# EasyEDA Pro project ProProject_Avaota Pi A_2024-03-25.epro, board PCB2 (continued)
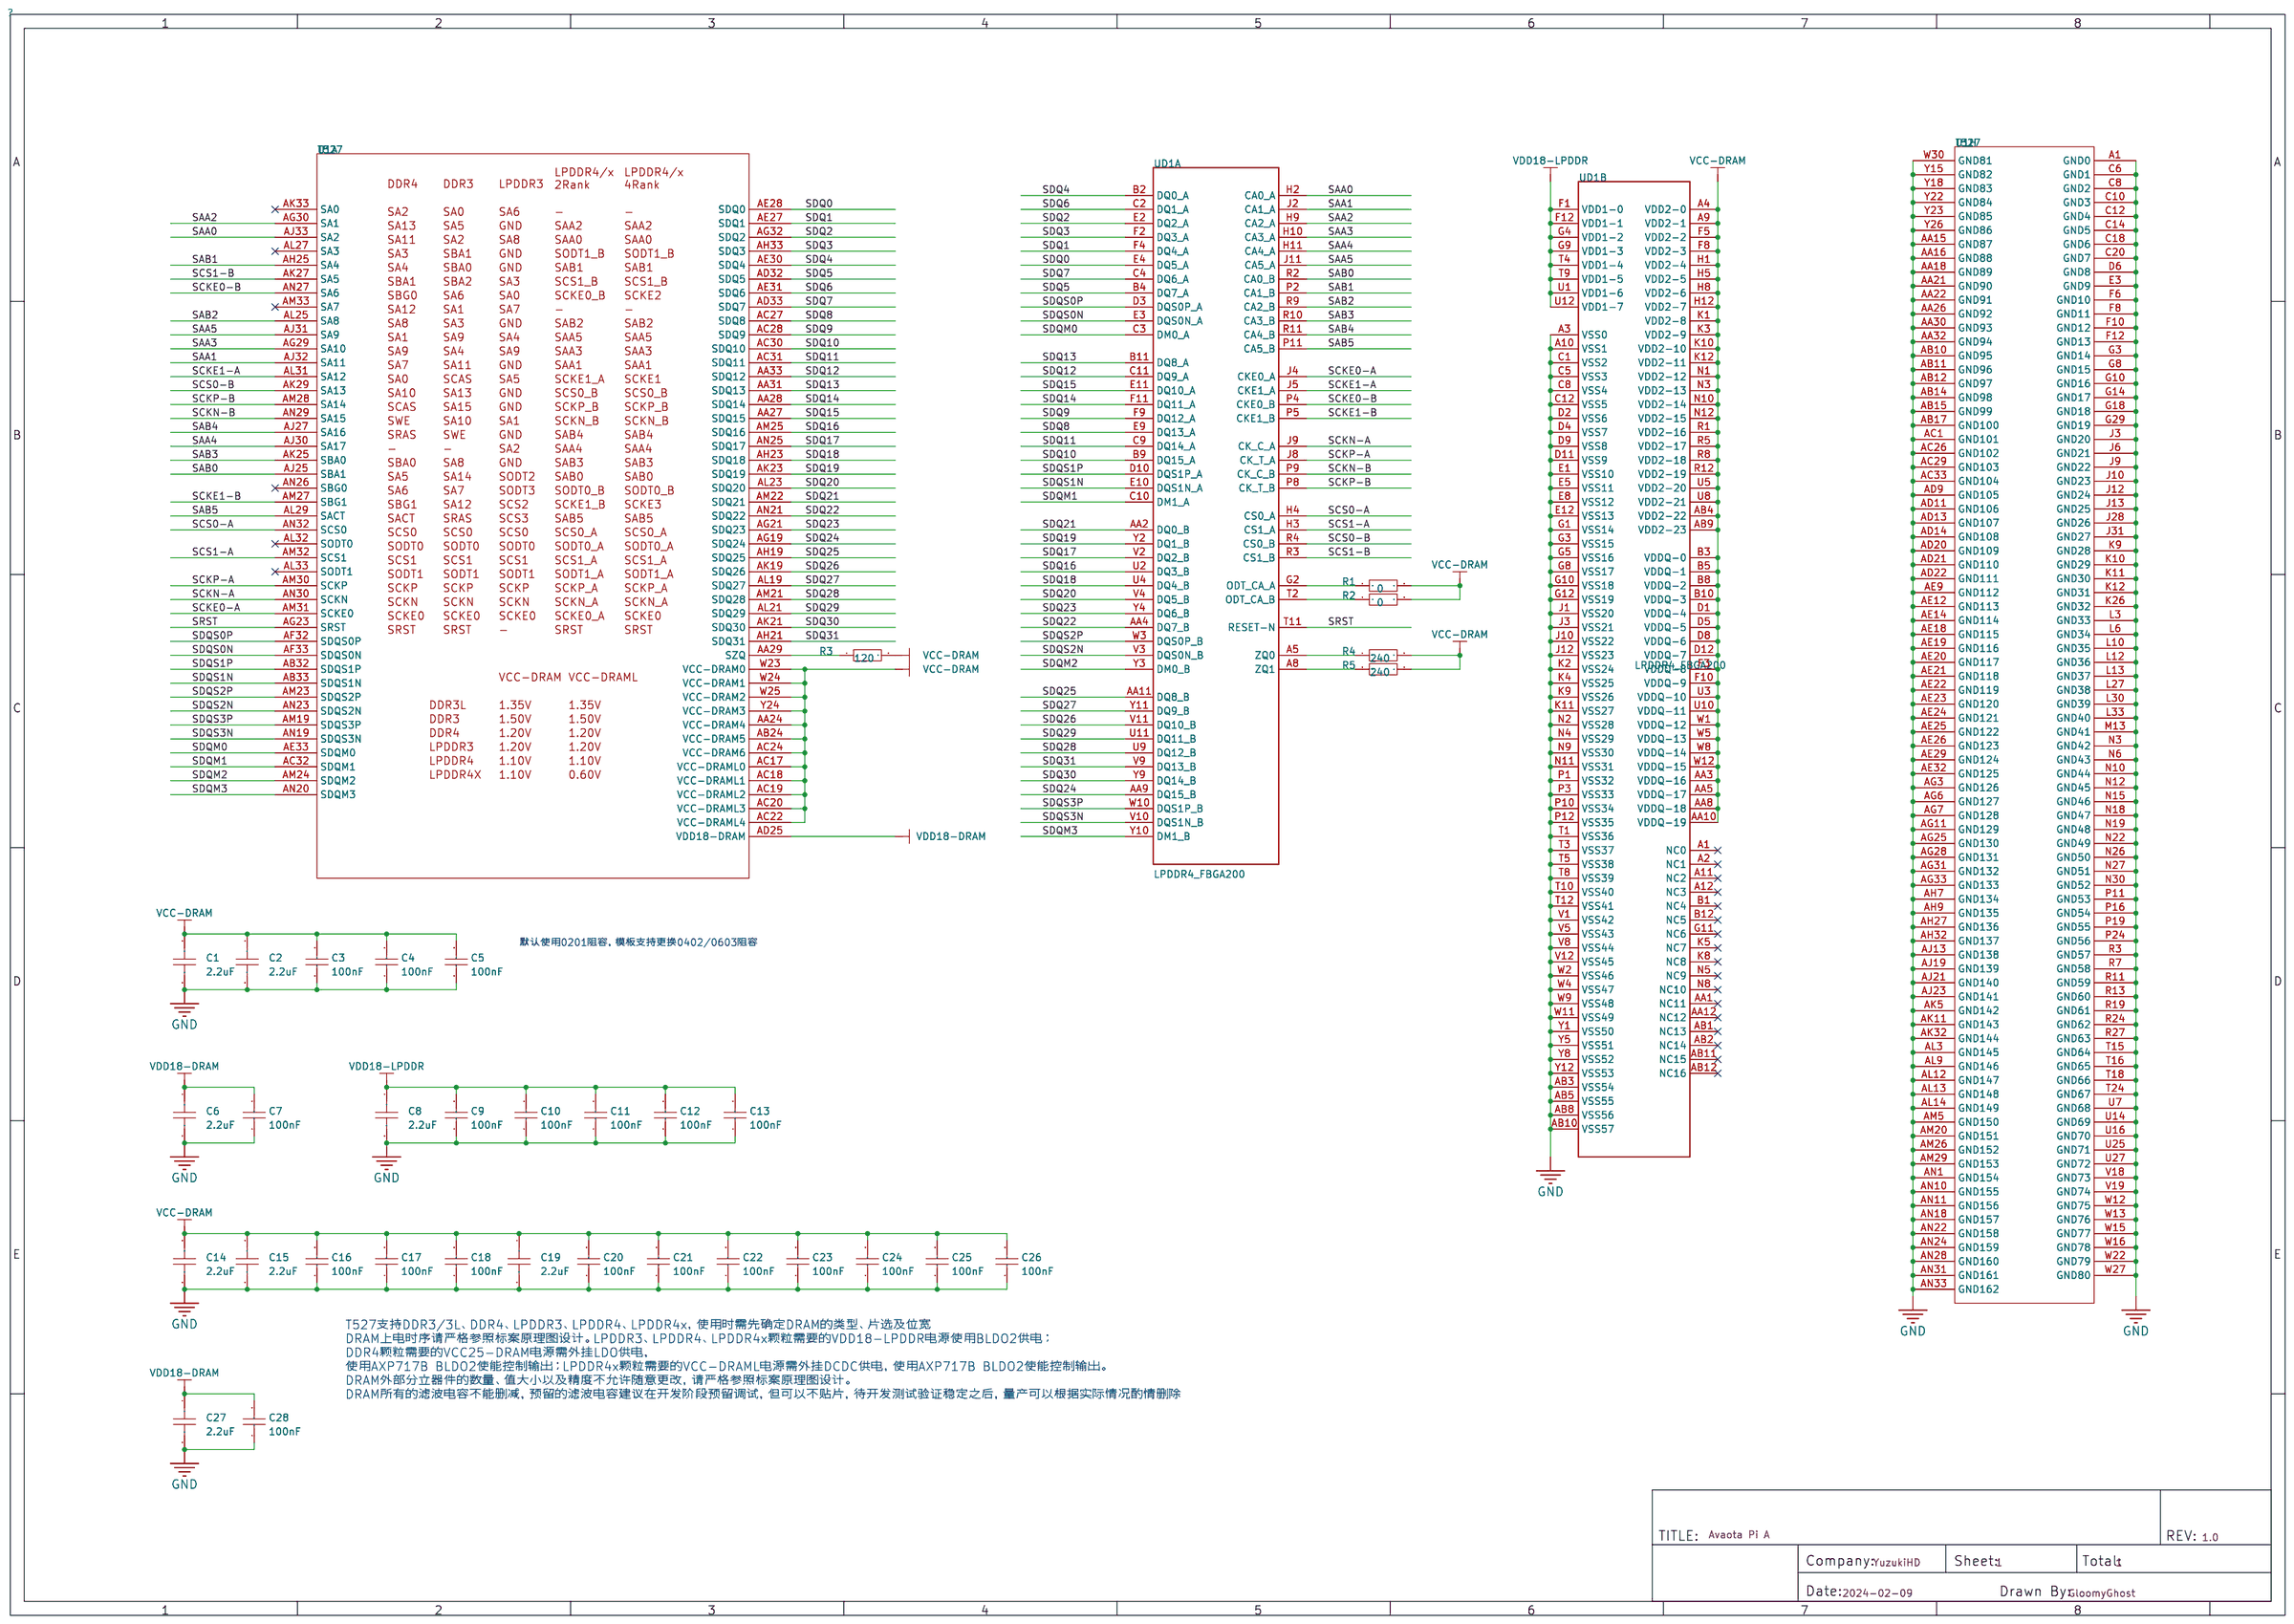
[diagram p0: schematic sheet]
## Routing (per net, layer and track width the routed paths; a pad name or vN(x,y) marks a point on that pad's centre or on a via; arc(x,y) is an arc through that point) (continued)
  Top Layer w0.381: 27.83,15.6 26.63,15.6 26.22,16.01 v1(25.77,16.01)
  Inner1 w0.076: 40.18,10.97 40.16,10.95 39.52,10.95 39.5,10.97
  Inner2 w0.254: 22.39,19.93 20.35,17.88 v1(20.35,17.37)
  Bottom Layer w0.203: C16.1 31.3,17.92 v1(31.83,17.92) ; v1(33.99,19.84) 34.06,19.91 C14.2 ; C13.1 34.34,8.78 v1(34.34,8.61)
  Bottom Layer w0.254: v1(33.53,15.74) 33.4,15.6 32.99,15.6 C10.1 ; v1(38.33,17.78) 38.15,17.6 38.15,17.21 38.15,17.21 C23.1 ; v1(35.89,9.78) 36.39,10.28 C20.1 ; v1(31.79,15.66) 31.67,15.55 31.67,15.19 ; v1(40.77,12.95) 40.85,12.87 40.85,12.14 v1(40.72,12.01) ; v1(35.76,5.18) 35.88,5.3 35.88,5.62 ; v1(36.04,6.83) 36.64,6.83 C24.1 ; C26.1 35.93,18.36 v1(35.97,18.33) 36.52,18.33 C25.1 ; v1(31.8,8.32) 31.95,8.47 32.29,8.47 ; v1(32.79,13.72) 32.87,13.64 32.87,13.11
  vias: v1(17.44,15.89) v1(20.04,9.16) v1(24.74,4.01) v1(25.78,2.97) v1(39.33,2.46)
VCC-DRAM: length 65.7
  Top Layer w0.203: 19.29,14.15 v1(19.61,14.47)
  Top Layer w0.254: 33.94,16.12 34.29,15.77 34.31,15.77 v1(34.31,15.76) ; v1(37.39,15.93) 37.44,15.88 v1(37.44,14.94) 37.56,14.82 37.94,14.82 ; v1(37.39,15.93) 37.54,15.87 37.9,16.02 37.94,16.12 ; v1(37.39,15.93) 37.36,15.96 36.87,15.96 v1(36.7,16.13) 36.69,16.12 35.54,16.12 ; v1(31.85,17.42) 32.32,17.42 UD1.D1 ; v1(37.57,17.6) 37.75,17.42 37.94,17.42 ; v1(17.51,11.72) 17.16,11.37 v1(17.16,11.35) 17.1,11.35 16.81,11.65 16.81,11.67 ; v1(17.51,11.72) 17.85,12.06 v1(17.88,12.06) 17.57,12.38 17.52,12.38 18.19,13.05 v1(18.19,13.09) 18.23,13.09 19.29,14.15 ; v1(17.51,11.72) 17.47,11.72 17.16,12.02 ; v1(39.94,8.67) 39.94,8.71 39.69,8.97 39.54,8.97 ; 35.54,8.97 35.8,8.97 36.07,9.24 v1(36.07,9.25) ; v1(19.25,14.83) 19.78,15.36 v1(19.84,15.36) ; v1(19.25,14.83) v1(18.89,15.19) ; v1(19.25,14.83) v1(19.61,14.47) ; v1(19.25,14.83) 19.25,14.82 18.93,14.5 ; 32.34,14.82 31.54,14.82 30.94,15.42 v1(30.94,15.65) 30.8,15.51 30.31,15.51 30.22,15.6 29.89,15.6 ; 35.54,10.27 36.11,10.27 v1(36.65,9.73) ; R1.2 29.69,16.06 29.69,15.8 29.89,15.6 ; C5.2 28.58,15.6 29.89,15.6 ; 18.22,15.21 18.56,15.54 18.56,15.58 ; 18.22,15.21 18.58,14.85 ; 18.22,15.21 17.87,15.56 ; 39.54,18.72 39.6,18.72 v1(39.91,18.42) ; 35.54,7.67 35.79,7.42 v1(36.12,7.42) ; C4.2 41.9,9.5 UD1.R12 41.13,10.27 v1(40.82,10.59) ; 39.54,6.37 39.58,6.37 v1(39.97,5.98) ; v1(37.47,18.84) 37.59,18.72 37.94,18.72 ; 18.56,15.58 18.22,15.91 ; 18.56,15.58 18.89,15.25 v1(18.89,15.19) ; v1(18.89,15.19) 18.58,14.88 18.58,14.85 ; v1(38.39,7.34) 38.33,7.34 38,7.67 37.94,7.67 ; 35.54,14.82 35.49,14.82 v1(35.15,14.48) ; v1(35.97,17.74) 35.84,17.74 35.54,17.44 35.54,17.42 ; 33.94,11.57 33.84,11.57 v1(33.55,11.28) ; 33.94,6.37 34.1,6.37 v1(34.37,6.1) ; v1(41.54,14.52) 41.43,14.52 41.14,14.82 ; v1(41.54,14.52) 41.54,13.8 ; v1(41.54,14.52) 41.55,14.54 42.2,14.54 C3.2 ; 38.74,5.72 38.74,5.27 v1(38.7,5.23) ; 32.34,13.52 31.98,13.52 v1(31.83,13.67) ; 37.94,6.37 37.57,6.37 v1(37.52,6.41) ; 33.94,8.97 33.94,8.95 v1(33.58,8.59) ; 17.16,12.02 17.52,12.38 ; 17.16,12.02 16.81,11.67 ; 32.34,7.67 31.65,7.67 31.34,7.36 31.34,7.21 ; v1(38.84,19.84) 38.74,19.74 38.74,19.37 ; 33.94,13.52 33.7,13.52 v1(33.56,13.67) ; 18.93,14.5 19.29,14.15 ; 18.93,14.5 18.58,14.85 ; 19.29,14.15 v1(19.68,13.75) ; 41.54,13.8 v1(41.48,13.74) 41.37,13.74 41.14,13.52 ; 41.54,13.8 41.67,13.93 C1.1 ; v1(34.5,5.31) 34.74,5.56 34.74,5.72 ; 35.54,18.72 v1(35.84,19.02) ; 33.94,18.72 v1(34.29,18.37) ; 41.14,17.42 41.32,17.42 v1(41.58,17.68) 41.78,17.88 C17.2 ; 17.87,15.56 18.22,15.91 ; 17.87,15.56 17.52,15.21 ; v1(39.95,16.39) 39.67,16.12 39.54,16.12 ; 37.94,8.97 37.49,9.41 v1(37.49,9.8) 37.94,10.25 37.94,10.27 ; 41.14,7.67 41.28,7.67 v1(41.58,7.37) 41.91,7.04 C18.2 C2.1 ; 30.74,9.71 30.84,9.71 v1(31.22,10.08) 31.4,10.27 32.34,10.27 ; v1(41.4,11.94) 41.14,11.68 41.14,11.57 ; v1(34.73,19.87) 34.74,19.86 34.74,19.37 ; v1(36.09,6.22) 35.95,6.37 35.54,6.37 ; 32.34,11.57 31.99,11.57 v1(31.8,11.38) ; 39.54,11.57 39.54,11.65 v1(39.9,12.01) 40.03,12.14 40.03,12.85 v1(39.9,12.98) 39.54,13.34 39.54,13.52
  Bottom Layer w0.076: 39.78,14.86 40.13,14.86
  Bottom Layer w0.115: R3.2 19.84,15.37 v1(19.84,15.36)
  Bottom Layer w0.203: v1(34.73,19.87) 34.63,19.97 C14.1 ; v1(31.85,17.42) 31.78,17.35 C16.2
  Bottom Layer w0.254: C25.2 36.54,17.74 v1(35.97,17.74) ; C21.2 35.27,5.62 34.81,5.62 v1(34.5,5.31) ; 36.44,19.23 36.05,19.23 v1(35.84,19.02) ; 38.15,16.36 37.82,16.36 v1(37.39,15.93) ; v1(33.56,13.67) 33.44,13.55 C15.1 ; v1(37.47,18.84) 38.03,18.84 R5.2 ; v1(33.58,8.59) 33.46,8.47 33.14,8.47 ; C26.2 34.29,18.36 v1(34.29,18.37) ; v1(30.94,15.65) 31.1,15.48 C19.1 ; v1(37.49,9.8) 37,10.3 37,10.32 ; v1(39.9,12.01) 40.04,12.15 40.04,12.45 40,12.49 40.02,12.51 40.02,12.87 v1(39.9,12.98) ; v1(36.12,7.42) 36.14,7.39 C24.2
  vias: v1(31.34,7.21)
VDD18-DRAM: length 30.2
  Top Layer w0.254: C7.2 42.24,19.76 v1(41.4,20.6) 41.43,20.63 C6.1 ; C27.1 27.05,17.09 v1(26.7,16.74) 26.87,16.56 C28.2
  Top Layer w0.305: U1.AD25 20.28,14.44 v1(20.32,14.44) ; v1(30.59,18.54) 31.82,19.78 32.78,19.78 v1(32.97,19.96)
  Inner2 w0.305: v1(30.59,18.54) 30.59,17.61 30.33,17.35 28.02,17.35 27.65,16.98 26.94,16.98 v1(26.7,16.74) 26.47,16.51 25.55,16.51 25.17,16.13 24.08,16.13 22.26,14.31 22.1,14.31 21.49,13.7 21.06,13.7 v1(20.32,14.44) ; v1(41.4,20.6) 40.44,21.56 39.52,21.56 38.31,20.35 37.75,20.35 37.26,19.86 36.25,19.86 35.76,20.35 33.35,20.35 32.97,19.98 v1(32.97,19.96)
VDD18-LPDDR: length 36.9
  Top Layer w0.102: 38.74,9.62 v1(39.09,9.96)
  Top Layer w0.254: C11.2 42.16,8.95 41.78,8.95 v1(41.45,9.27) 41.14,8.97 ; 34.74,15.47 34.85,15.47 35.17,15.79 v1(35.17,15.89) ; C8.1 41.71,11.52 v1(41.71,11.51) 42.04,11.51 C12.2 ; v1(38.36,15.08) 38.74,15.47 ; v1(32.72,16.53) 32.72,16.48 32.35,16.12 32.34,16.12 ; v1(35.15,9.2) 35.15,9.2 34.74,9.62 ; 42.24,16.51 42.08,16.51 v1(41.68,16.12) 41.14,16.12
  Top Layer w0.305: 32.34,8.97 32.66,9.28 v1(32.73,9.28)
  Inner2 w0.254: v1(32.73,9.28) 35.07,9.28 v1(35.15,9.2)
  Inner2 w0.305: v1(41.71,11.51) 41.64,11.51 41.33,11.19 41.33,9.4 v1(41.45,9.27) 40.74,9.27 40.05,9.96 v1(39.09,9.96) 38.69,10.36 35.84,10.36 35.15,9.67 v1(35.15,9.2) ; v1(41.6,13.08) 41.68,13.08 42.09,13.49 42.09,15.73 41.71,16.12 v1(41.68,16.12) 41.47,15.9 39.17,15.9 38.36,15.09 v1(38.36,15.08) 38.03,15.42 36.72,15.42 36.16,15.98 35.25,15.98 v1(35.17,15.89) 35.17,16.06 34.62,16.61 32.79,16.61 v1(32.72,16.53)
  Bottom Layer w0.203: C13.2 33.24,9.28 v1(32.73,9.28)
  Bottom Layer w0.254: 32.39,16.2 32.39,16.21 v1(32.72,16.53)
  Bottom Layer w0.305: v1(41.71,11.51) 42.26,12.06 42.26,12.67 41.85,13.08 v1(41.6,13.08)
SAA0: length 9.3
  Top Layer w0.076: 24.59,15.21 25.03,15.65 26.08,15.65
  Top Layer w0.115: 33.14,14.82 32.83,14.82 32.56,14.55 31.18,14.55 30.71,15.02 26.71,15.02 26.08,15.65
SAA1: length 9.8
  Top Layer w0.076: 25.99,15.29 25.03,15.29 24.59,14.85 24.24,14.85
  Top Layer w0.115: 33.14,14.17 32.73,14.17 32.72,14.15 32.71,14.15 32.45,13.9 32.21,13.9 32.06,14.05 31.16,14.05 30.56,14.66 26.62,14.66 25.99,15.29
SAA2: length 18.5
  Top Layer w0.102: v1(23.55,14.9) 22.87,14.9 22.82,14.85 ; 38.74,14.82 v1(39.14,15.22)
  Inner2 w0.115: v1(23.55,14.9) 23.6,14.9 24.27,15.57 26.7,15.57 27.24,16.11 33.84,16.11 33.85,16.12 34.5,16.12 34.71,15.92 34.71,15.7 34.89,15.52 35.38,15.52 36.04,14.87 36.04,14.87 36.25,14.65 36.25,14.65 36.39,14.51 38.44,14.51 38.55,14.62 38.55,14.62 38.82,14.89 38.82,14.9 v1(39.14,15.22)
SAA3: length 19
  Top Layer w0.102: 23.22,14.51 23.17,14.46 22.5,14.46 22.47,14.5
  Top Layer w0.115: v1(39.21,14.53) 39.26,14.53 39.54,14.82
  Inner2 w0.115: v1(39.21,14.53) 39.21,14.48 38.01,13.29 29.05,13.29 27.03,15.32 24.5,15.32 23.64,14.46 23.28,14.46 23.23,14.51 v1(23.22,14.51)
SAA4: length 19.1
  Top Layer w0.102: v1(40.02,14.49) 40.34,14.82
  Top Layer w0.115: 23.53,14.15 v1(23.85,13.82)
  Inner2 w0.076: 23.85,14.24 24.13,14.51 27.31,14.51
  Inner2 w0.115: v1(40.02,14.49) 40.02,14.16 38.77,12.92 28.9,12.92 27.31,14.51 ; v1(23.85,13.82) 23.85,14.24
SAA5: length 19.1
  Top Layer w0.115: 23.88,14.5 24.2,14.18 v1(24.26,14.18) ; v1(40.77,14.48) 40.65,14.48 40.34,14.17
  Inner2 w0.076: v1(24.26,14.18) 24.3,14.22 26.97,14.22
  Inner2 w0.115: v1(40.77,14.48) 40.77,14.4 38.92,12.55 28.65,12.55 26.97,14.22
SAB0: length 13
  Top Layer w0.115: v1(22.06,12.73) 21.76,12.43 21.76,12.38 ; 33.14,10.27 32.87,10.54 31.04,10.54 30.76,10.26 v1(29.57,10.26)
  Inner2 w0.076: 26.25,11.45 25.3,11.43 24.48,11.43 23.95,11.96 23.55,11.96 22.78,12.73 v1(22.06,12.73)
  Inner2 w0.115: v1(29.57,10.26) 29.34,10.03 28.6,10.03 28.34,10.28 27.43,10.28 26.25,11.45
SAB1: length 13.6
  Top Layer w0.115: v1(28.84,10.4) 28.89,10.4 29.16,10.67 29.84,10.67 30.26,11.08 30.96,11.08 31.06,10.97 31.9,10.97 32.16,11.23 32.49,11.23 32.8,10.92 33.14,10.92 ; 21.41,12.73 21.41,12.83 v1(21.68,13.11)
  Inner2 w0.076: 26.07,12.15 23.59,12.15 22.83,12.9 22.5,12.9 22.3,13.11 v1(21.68,13.11)
  Inner2 w0.115: 26.07,12.15 27.57,10.66 28.56,10.66 28.82,10.4 v1(28.84,10.4)
SAB2: length 19.3
  Top Layer w0.102: v1(38.36,9.88) 38.74,10.27
  Top Layer w0.115: 22.47,11.67 v1(22.79,12)
  Inner2 w0.076: v1(22.79,12) 23.37,11.42 23.99,11.42 24.38,11.02 25.32,11.02 25.43,10.92
  Inner2 w0.115: 25.43,10.92 25.74,10.92 28.43,8.23 31.24,8.23 31.51,7.95 32.42,7.95 32.62,8.15 37.01,8.15 37.64,8.79 37.64,9.17 v1(38.36,9.88)
SAB3: length 20.9
  Top Layer w0.115: 22.11,12.02 22.11,12.07 v1(22.42,12.37) ; 39.54,10.27 39.22,10.59 37.59,10.59 37.12,10.12 v1(37.12,8.85)
  Inner2 w0.076: 25.88,11.12 25.5,11.12 25.43,11.2 24.46,11.2 23.9,11.76 23.53,11.76 22.92,12.37 v1(22.42,12.37)
  Inner2 w0.115: 25.88,11.12 26.06,11.12 28.35,8.83 33.31,8.83 33.45,8.97 34.62,8.97 34.82,8.76 35.64,8.76 35.76,8.89 37.09,8.89 v1(37.12,8.85)
SAB4: length 20.6
  Top Layer w0.102: v1(22.8,13.37) 22.79,13.35 22.73,13.35 22.47,13.09 ; v1(39.93,10.62) 39.99,10.62 40.34,10.27
  Inner2 w0.076: v1(22.8,13.37) 23.31,13.37 24,12.67
  Inner2 w0.115: v1(39.93,10.62) 39.19,10.62 38.15,11.66 34.95,11.66 34.8,11.51 34.8,11.05 34.53,10.78 34.15,10.78 34.03,10.9 31.06,10.9 30.54,11.43 27.89,11.43 26.26,13.06 25.51,13.06 25.13,12.67 24,12.67
SAB5: length 17.9
  Top Layer w0.102: v1(39.96,11.29) 40.34,10.92
  Top Layer w0.115: 23.88,13.09 v1(24.22,13.42)
  Inner2 w0.115: v1(39.96,11.29) 39.09,12.17 28.22,12.17 26.95,13.44 26.64,13.44 26.36,13.72 24.51,13.72 v1(24.22,13.42)
SCKE0-A: length 10.9
  Top Layer w0.076: 26.27,13 25.74,13 25.55,13.19 25.55,13.19 25.4,13.34 25.05,13.34 24.94,13.44
  Top Layer w0.115: 34.74,14.17 34.74,14.16 34.42,13.84 v1(34.32,13.84) ; v1(30.74,13.69) 30.52,13.47 29.18,13.47 28.56,12.85 26.42,12.85 26.27,13
  Inner2 w0.115: v1(30.74,13.69) 31.27,14.22 33.05,14.22 33.22,14.05 33.76,14.05 33.97,13.84 v1(34.32,13.84)
SCKE0-B: length 13.2
  Top Layer w0.076: 23.88,11.67 24.53,11.02 25.06,11.02 25.64,10.44
  Top Layer w0.102: 34.74,10.92 34.86,10.92 v1(35.16,10.62)
  Top Layer w0.115: v1(29.02,9.64) 28.92,9.54 27.83,9.54 27.2,10.17 26.07,10.17 25.8,10.44 25.64,10.44
  Inner2 w0.115: v1(35.16,10.62) 35.01,10.48 34.1,10.48 33.71,10.09 31.76,10.09 31.29,9.63 29.03,9.63 v1(29.02,9.64)
SCKE1-A: length 13.3
  Top Layer w0.076: 24.59,13.79 24.94,13.79 25.19,13.54 25.4,13.54 25.55,13.69 25.75,13.69 25.9,13.54 26.47,13.54
  Top Layer w0.102: 35.54,14.17 35.55,14.17 v1(35.89,14.5)
  Top Layer w0.115: 26.47,13.54 26.51,13.49 28.33,13.49 29.08,14.25 v1(29.31,14.25)
  Inner2 w0.115: v1(29.31,14.25) 29.71,13.85 30.36,13.85 31.05,14.54 33.08,14.54 33.33,14.78 33.73,14.78 34.3,14.21 34.56,14.21 34.65,14.12 35.51,14.12 v1(35.89,14.5)
SCKE1-B: length 15.2
  Top Layer w0.076: 23.53,12.02 23.88,12.02 24.68,11.23 25.09,11.23 25.68,10.64 25.87,10.64
  Top Layer w0.102: 35.54,10.92 35.85,11.23 v1(35.89,11.23)
  Top Layer w0.115: v1(28.05,9.9) 28.05,10.05 27.57,10.54 25.97,10.54 25.87,10.64
  Inner2 w0.115: v1(28.05,9.9) 28.08,9.88 28.23,9.88 28.91,9.19 31.38,9.19 31.87,9.68 34.71,9.68 35.89,10.86 v1(35.89,11.23)
SCKN-A: length 15.6
  Top Layer w0.076: 24.94,12.73 25.01,12.73 25.62,12.12 26.23,12.12 26.26,12.09 ; 38.74,14.17 38.53,14.17 38.44,14.08 38.44,13.26 38.47,13.23 38.47,13.21
  Top Layer w0.127: 38.47,13.21 38.47,12.93 38.24,12.7 29.66,12.7 29.04,12.09 26.26,12.09
SCKN-B: length 16.1
  Top Layer w0.076: 38.74,10.92 38.56,10.92 38.46,11.03 38.46,11.87 38.09,12.24 37.78,12.24 37.73,12.29 37.72,12.29 ; 24.59,12.38 24.66,12.31 24.87,12.31 25.17,12 25.17,11.88 25.72,11.34 26.32,11.34 26.35,11.37
  Top Layer w0.127: 26.35,11.37 26.48,11.5 29.17,11.5 29.96,12.29 37.72,12.29
SCKP-A: length 15.6
  Top Layer w0.076: 38.21,13.21 38.21,13.23 38.24,13.26 38.24,14.09 38.16,14.17 37.94,14.17 ; 24.59,13.09 24.94,13.09 25.71,12.32 26.22,12.32 26.25,12.34 26.26,12.34
  Top Layer w0.127: 26.26,12.34 28.94,12.34 29.55,12.96 38.14,12.96 38.21,13.03 38.21,13.21
SCKP-B: length 16.9
  Top Layer w0.076: 26.48,11.14 25.67,11.14 24.97,11.84 24.97,11.92 24.78,12.1 24.51,12.1 24.02,12.6 23.9,12.6 23.83,12.52 23.83,12.43 23.88,12.38 ; 37.94,10.92 38.21,10.92 38.29,10.99 38.29,11.75 38,12.03 37.72,12.03
  Top Layer w0.127: 37.72,12.03 30.06,12.03 29.27,11.24 26.58,11.24 26.48,11.14
SCS0-A: length 11.2
  Top Layer w0.076: 26.4,13.3 25.79,13.3 25.65,13.44
  Top Layer w0.115: v1(35.15,15.11) 35.15,15.11 34.86,14.82 34.74,14.82 ; 26.4,13.3 26.52,13.18 28.42,13.18 29.1,13.86 29.81,13.86 v1(30.2,14.25)
  Inner2 w0.115: v1(35.15,15.11) 34.74,14.69 34.21,14.69 33.85,15.05 32.92,15.05 32.78,14.91 30.86,14.91 v1(30.2,14.25)
SCS0-B: length 14.8
  Top Layer w0.102: v1(34.37,11.23) 34.37,10.87 34.74,10.5 34.74,10.27
  Top Layer w0.115: 23.53,13.44 22.99,13.98 v1(22.99,14.06)
  Inner2 w0.115: v1(34.37,11.23) 33.79,11.8 28.04,11.8 26.75,13.1 26.57,13.1 26.34,13.32 25.24,13.32 24.95,13.03 24.1,13.03 23.17,13.97 23.08,13.97 22.99,14.06
SCS1-A: length 10.3
  Top Layer w0.076: 25.3,13.79 25.4,13.9 25.75,13.9 26.13,14.27
  Top Layer w0.115: v1(34.35,15.09) 34.34,15.09 34.31,15.06 34.29,15.06 34.05,14.82 33.94,14.82 ; 26.13,14.27 v1(28.58,14.27)
  Inner2 w0.115: v1(28.58,14.27) 29.59,15.29 31.93,15.29 32.01,15.37 34.06,15.37 34.34,15.09 v1(34.35,15.09)
SCS1-B: length 12.5
  Top Layer w0.102: 22.82,12.73 23.12,13.03 v1(23.18,13.03)
  Top Layer w0.115: v1(33.66,10.54) 33.94,10.27
  Inner2 w0.076: v1(23.18,13.03) 23.88,12.33 26.42,12.33
  Inner2 w0.115: v1(33.66,10.54) 33.58,10.46 31.01,10.46 30.91,10.36 30.31,10.36 29.61,11.05 27.7,11.05 26.42,12.33
SDQ0: length 18.5
  Top Layer w0.115: v1(21.65,14.52) 21.41,14.77 21.41,14.85 ; 34.74,16.77 34.78,16.77 35.05,17.04 35.1,17.04 35.12,17.06 v1(35.13,17.06)
  Inner2 w0.115: v1(21.65,14.52) 21.65,15.2 23.37,16.92 23.6,16.92 24.79,18.11 25.57,18.11 27.34,19.88 28.84,19.88 29.22,20.26 31.39,20.26 32.67,18.98 33.13,18.98 33.74,18.37 33.74,18.36 35.04,17.06 v1(35.13,17.06)
SDQ1: length 22.2
  Top Layer w0.076: v1(21.28,14.18) 21.28,14.28 21.05,14.5
  Top Layer w0.115: v1(36.04,16.53) 36.02,16.51 35.92,16.51 35.91,16.5 35.12,16.5 34.74,16.12 34.74,16.12
  Inner2 w0.115: v1(36.04,16.53) 35.51,17.07 35.51,17.86 33.9,19.48 32.78,19.48 31.57,20.68 28.87,20.68 28.6,20.41 27.29,20.41 25.24,18.36 24.72,18.36 23.58,17.23 23.21,17.23 21.28,15.29 v1(21.28,14.18)
SDQ2: length 11.8
  Top Layer w0.076: 23.53,15.56 23.88,15.56 24.58,16.26 25.1,16.26
  Top Layer w0.115: 33.14,16.77 32.84,17.07 31.37,17.07 31.24,17.2 28.95,17.2 28.43,17.71 28.43,17.87 28.32,17.98 28.16,17.98 28.05,17.87 28.05,17.71 27.94,17.6 27.78,17.6 27.67,17.71 27.67,17.87 27.56,17.98 27.4,17.98 27.29,17.87 27.29,17.71 27.17,17.6 26.69,17.6 25.81,16.71 25.56,16.71 25.1,16.26
SDQ3: length 10.1
  Top Layer w0.076: 25.23,16.06 24.74,16.06 24.24,15.56
  Top Layer w0.115: 33.14,16.12 32.78,16.12 32.51,15.85 32.14,15.85 31.22,16.77 29.6,16.77 28.97,16.14 26.6,16.14 26.34,16.41 25.58,16.41 25.23,16.06
SDQ4: length 13.5
  Top Layer w0.115: 22.11,15.56 22.12,15.56 v1(22.45,15.23) ; v1(30.02,18.03) 30.81,18.03 31.83,19.05 32.81,19.05 33.14,18.72
  Inner2 w0.115: v1(30.02,18.03) 29.67,18.39 26.49,18.39 25.4,17.29 24.3,17.29 23.07,16.06 22.78,16.06 22.45,15.72 v1(22.45,15.23)
SDQ5: length 15.3
  Top Layer w0.076: 22.47,16.62 22.82,16.62 23.25,17.05 23.48,17.05 24.64,18.21
  Top Layer w0.115: 34.74,18.72 34.37,19.09 34.37,19.99 33.72,20.64 27.17,20.64 25.17,18.64 25.07,18.64 24.64,18.21
SDQ6: length 12.4
  Top Layer w0.115: 33.14,18.07 32.77,18.44 31.83,18.44 31,17.61 29.4,17.61 v1(29.11,17.91) ; 22.47,15.91 22.52,15.91 v1(22.83,15.6)
  Inner2 w0.115: v1(22.83,15.6) 22.94,15.6 24.31,16.97 25.84,16.97 26.78,17.91 v1(29.11,17.91)
SDQ7: length 16.7
  Top Layer w0.076: 22.82,16.97 23.2,17.35 23.55,17.35 24.07,17.88 24.07,18.14
  Top Layer w0.115: 24.07,18.14 26.99,21.06 34.09,21.06 35.1,20.04 35.1,18.43 34.74,18.07
SDQ8: length 24.7
  Top Layer w0.115: 38.74,16.77 38.41,17.1 37.51,17.1 37.06,17.55 v1(37.06,20.4) ; 20.35,15.21 20.35,15.58 v1(20.24,15.69)
  Inner2 w0.076: v1(20.24,15.69) 21.28,15.69
  Inner2 w0.115: 21.28,15.69 23.06,17.48 23.5,17.48 24.8,18.78 25.06,18.78 27.23,20.95 28.55,20.95 28.7,21.1 31.75,21.1 32.05,20.8 35.99,20.8 36.01,20.79 36.01,20.79 36.4,20.4 v1(37.06,20.4)
SDQ9: length 25.5
  Top Layer w0.115: v1(36.58,20.93) 36.64,20.86 36.64,16.8 37.03,16.42 38.11,16.42 38.32,16.2 38.65,16.2 38.74,16.12 ; v1(20.63,16.03) 20.7,15.96 20.7,15.56
  Inner2 w0.076: 23.42,18.39 21.06,16.03 v1(20.63,16.03)
  Inner2 w0.115: v1(36.58,20.93) 36.28,21.22 32.22,21.22 31.92,21.52 28.51,21.52 28.4,21.41 27.05,21.41 24.02,18.39 23.42,18.39
SDQ10: length 23.8
  Top Layer w0.076: v1(21.08,16.6) 21.41,16.27 21.41,16.27
  Top Layer w0.115: v1(38.1,20.85) 38.1,20.5 38.46,20.14 38.46,19 38.74,18.72
  Inner2 w0.076: 23.34,18.91 23.02,18.58 23.02,18.48 21.86,17.32 21.32,17.32 21.08,17.08 v1(21.08,16.6)
  Inner2 w0.115: v1(38.1,20.85) 38.1,21.37 37.08,22.4 28.63,22.4 28.38,22.65 27.08,22.65 23.34,18.91
SDQ11: length 23.2
  Top Layer w0.115: v1(21.46,16.98) 21.76,16.67 21.76,16.62 ; v1(37.36,21.08) 37.59,20.85 37.59,19.28 37.85,19.02 38.1,19.02 38.31,18.82 38.31,18.34 38.58,18.07 38.74,18.07
  Inner2 w0.076: v1(21.46,16.98) 21.73,16.98 23.42,18.67
  Inner2 w0.115: v1(37.36,21.08) 37.47,21.18 37.47,21.41 36.9,21.98 28.41,21.98 28.19,22.2 28.18,22.2 28.15,22.23 27.26,22.23 23.7,18.67 23.42,18.67
SDQ12: length 26.1
  Top Layer w0.076: 22.09,18.93 22,18.83 22,18.27 21.76,18.03
  Top Layer w0.115: 40.34,18.07 40.8,18.53 40.8,19.67 40.76,19.72 40.76,21.19 38.36,23.58 26.54,23.58 23.35,20.39 23.35,20.18 22.09,18.93
SDQ13: length 25.4
  Top Layer w0.076: 21.05,17.33 21.41,17.33 22.2,18.12 22.2,18.67 22.33,18.8
  Top Layer w0.115: 40.34,18.72 40.46,18.84 40.46,19.11 40.61,19.25 40.61,19.48 40.5,19.59 40.5,20.86 38.19,23.17 26.72,23.17 23.64,20.09 23.62,20.09 22.33,18.8
SDQ14: length 33.2
  Top Layer w0.115: v1(19.66,16.59) 19.98,16.27 19.99,16.27 ; v1(40.74,16.46) 40.4,16.12 40.34,16.12
  Inner2 w0.076: v1(19.66,16.59) 20.1,16.59 22.02,18.5 22.02,18.51
  Inner2 w0.115: v1(40.74,16.46) 40.79,16.46 41.58,17.25 41.67,17.25 42.16,17.75 42.16,17.77 42.27,17.87 42.27,21.23 39.93,23.57 26.76,23.57 22.02,18.84 22.02,18.51
SDQ15: length 32.1
  Top Layer w0.115: 19.64,15.91 19.61,15.91 v1(19.25,16.28) ; v1(40.79,17.09) 40.77,17.07 40.77,17.02 40.52,16.77 40.34,16.77
  Inner2 w0.076: v1(19.25,16.28) 19.35,16.18 19.97,16.18 22.25,18.46
  Inner2 w0.115: v1(40.79,17.09) 40.79,17.28 41.18,17.66 41.18,18.59 41.81,19.23 41.81,21.03 39.69,23.15 26.93,23.15 23.11,19.33 22.78,19.33 22.25,18.8 22.25,18.46
SDQ16: length 11.5
  Top Layer w0.076: 24.66,10.29 23.94,11 23.49,11 23.17,11.32 22.82,11.32
  Top Layer w0.115: 33.14,8.97 32.86,8.68 30.38,8.68 29.94,9.12 27.65,9.12 27.02,9.75 25.9,9.75 25.36,10.29 24.66,10.29
SDQ17: length 11.4
  Top Layer w0.076: 23.17,10.96 23.34,10.8 23.66,10.8 24.47,9.98
  Top Layer w0.115: 24.47,9.98 25.07,9.98 25.76,9.3 26.75,9.3 27.36,8.69 29.78,8.69 30.51,7.95 32.78,7.95 33.14,8.32
SDQ18: length 19.7
  Top Layer w0.115: 35.22,7.34 35.22,8.27 34.73,8.92 34.74,8.97 ; v1(21.09,12.36) 20.75,12.02 20.7,12.02
  Inner2 w0.076: v1(21.09,12.36) 21.12,12.33 21.63,12.33 21.74,12.22 21.9,12.22 23.04,11.07 23.65,11.07 24.63,10.09
  Inner2 w0.115: 24.63,10.09 25.41,10.09 26.93,8.57 27.68,7.51 29.15,6.03 33.75,6.03 34.55,6.83 35.13,7.26 35.2,7.34 v1(35.22,7.34)
SDQ19: length 14
  Top Layer w0.115: 33.14,7.02 33.01,7.02 32.74,6.75 31.12,6.75 29.6,8.27 26.71,8.27 v1(26.42,8.56) ; v1(21.8,11.63) 21.72,11.63 21.41,11.32
  Inner2 w0.076: 24.52,9.82 23.57,10.77 23.12,10.77 22.25,11.63 v1(21.8,11.63)
  Inner2 w0.115: v1(26.42,8.56) 26.35,8.56 25.09,9.82 24.52,9.82
SDQ20: length 18.4
  Top Layer w0.076: 34.69,8.26 35.04,7.91 35.04,7.62 34.9,7.48 34.9,7.41 34.88,7.39 34.88,7.23 34.94,7.18 34.94,7.16 35.1,6.99 35.1,6.67 v1(35.12,6.65)
  Top Layer w0.115: 21.76,10.96 21.84,10.96 v1(22.15,11.28)
  Inner2 w0.076: v1(22.15,11.28) 22.89,10.54 23.42,10.54 24.43,9.53
  Inner2 w0.115: v1(35.12,6.65) 35.12,6.34 34.45,5.67 34.34,5.67 34.29,5.61 28.98,5.61 27.1,7.5 26.81,7.5 24.78,9.53 24.43,9.53
SDQ21: length 14.1
  Top Layer w0.076: 23.82,8.61 23.11,8.61 22.25,9.47 22.19,9.47 21.76,9.9 21.76,10.26
  Top Layer w0.115: 23.82,8.61 26.33,6.11 28.65,6.11 29.31,5.45 32.45,5.45 33.14,6.14 33.14,6.37
SDQ22: length 16.8
  Top Layer w0.076: 23.45,8.38 23.14,8.38 23.07,8.46 23.05,8.46 22.23,9.28 22.03,9.28 21.76,9.55
  Top Layer w0.115: 34.74,6.37 34.81,6.37 35.18,5.99 35.18,5.31 34.75,4.88 33,4.88 32.85,5.03 29.14,5.03 28.47,5.69 26.14,5.69 23.45,8.38
SDQ23: length 19.4
  Top Layer w0.115: 34.74,7.02 34.55,7.02 34.24,6.71 33.83,6.71 33.56,6.43 33.56,5.46 v1(33.31,5.22) ; v1(20.01,12.05) 20.01,12.04 19.64,11.67
  Inner2 w0.076: 24.31,9.35 24.31,9.38 23.37,10.31 22.65,10.31 20.92,12.05 v1(20.01,12.05)
  Inner2 w0.115: 24.31,9.35 24.41,9.31 26.64,7.08 26.87,7.08 28.76,5.18 33.27,5.18 v1(33.31,5.22)
SDQ24: length 24
  Top Layer w0.115: 18.93,10.96 19.29,11.32 19.29,11.33 v1(19.32,11.37) ; v1(26.73,4.78) 26.8,4.85 28.07,4.85 28.73,4.19 35.99,4.19 37.82,6.02 38.4,6.02 38.74,6.37
  Inner2 w0.076: v1(19.32,11.37) 20.18,11.37 22.33,9.22
  Inner2 w0.115: 22.33,9.22 22.33,9.02 26.51,4.84 26.57,4.84 26.63,4.78 v1(26.73,4.78)
SDQ25: length 27.1
  Top Layer w0.115: 19.29,10.61 19.34,10.61 19.64,10.91 19.64,10.95 v1(19.67,10.98) ; 40.34,6.37 40.61,6.09 40.61,5.26 40.16,4.8 39.41,4.8 39.15,4.55 38.18,4.55 36.98,3.35 28.38,3.35 27.74,3.99 27.13,3.99 27.06,3.93 v1(26.99,3.93)
  Inner2 w0.076: 22.02,9.12 22.02,9.31 20.41,10.92 19.73,10.92 v1(19.67,10.98)
  Inner2 w0.115: v1(26.99,3.93) 26.83,3.93 26.4,4.36 26.39,4.36 23.11,7.65 23.11,7.65 22.89,7.87 22.89,8.06 22.02,8.92 22.02,9.12
SDQ26: length 29
  Top Layer w0.115: 19.99,9.9 20.07,9.9 v1(20.38,10.22) ; v1(40.77,8) 40.45,8.32 40.34,8.32
  Inner2 w0.076: v1(20.38,10.22) 20.42,10.25 20.86,10.25 21.51,9.6 21.51,9.25
  Inner2 w0.115: 21.51,9.25 21.51,8.44 21.81,8.15 21.82,8.15 22.62,7.35 22.81,7.35 26.22,3.94 26.22,3.94 26.91,3.25 39.34,3.25 40.36,4.28 40.36,7.59 v1(40.77,8)
SDQ27: length 27.8
  Top Layer w0.115: v1(40.79,4.73) 40.84,4.78 40.84,6.51 UD1.Y11 ; v1(20.75,9.87) 20.67,9.87 20.35,9.55
  Inner2 w0.076: v1(20.75,9.87) 21.21,9.41 21.21,9.34
  Inner2 w0.115: 21.21,9.34 21.21,8.42 22.51,7.12 22.51,7.05 26.05,3.52 26.05,3.52 26.74,2.83 39.51,2.83 40.79,4.11 v1(40.79,4.73)
SDQ28: length 23
  Top Layer w0.076: 21.41,9.9 21.41,9.55 21.87,9.09 22.19,9.09 23.23,8.05 23.23,8
  Top Layer w0.115: 38.74,8.97 38.6,8.97 38.27,8.64 37.44,8.64 36.98,8.18 36.98,5.7 35.9,4.61 28.96,4.61 28.3,5.27 25.97,5.27 23.23,8
SDQ29: length 26.8
  Top Layer w0.115: v1(40.74,8.71) 40.49,8.97 40.34,8.97 ; v1(21.46,10.58) 21.14,10.26 21.05,10.26
  Inner2 w0.076: v1(21.46,10.58) 21.74,10.29 21.74,10.22 22.61,9.36
  Inner2 w0.115: v1(40.74,8.71) 40.34,8.31 39.7,8.31 39.57,8.43 39.11,8.43 38.78,8.1 38.78,6.15 38.26,5.64 38.26,5.2 36.98,3.92 28.2,3.92 26.87,5.26 26.68,5.26 23.3,8.64 23.04,8.64 22.61,9.07 22.61,9.36
SDQ30: length 22.2
  Top Layer w0.102: v1(38.33,6.6) 38.74,7.02
  Top Layer w0.115: 20.7,10.61 20.77,10.61 v1(21.09,10.93)
  Inner2 w0.076: v1(21.09,10.93) 21.57,10.93 21.97,10.53 21.97,10.34 22.89,9.42 23.07,9.42
  Inner2 w0.115: 23.07,9.42 23.29,9.42 23.64,9.08 23.64,8.89 26.69,5.84 26.87,5.84 28.38,4.34 36.07,4.34 v1(38.33,6.6)
SDQ31: length 23.8
  Top Layer w0.115: v1(38.42,8.04) 38.47,8.04 38.74,8.32 ; 19.99,11.32 20.04,11.32 20.36,11.63 v1(20.36,11.67)
  Inner2 w0.076: v1(20.36,11.67) 20.38,11.64 21.07,11.64 23.06,9.65 23.52,9.65
  Inner2 w0.115: v1(38.42,8.04) 38.42,7.97 38,7.55 38,7.16 37.79,6.95 37.55,6.95 37.03,6.44 37.03,5.94 35.85,4.76 28.55,4.76 27.05,6.26 26.86,6.26 24.29,8.83 24.29,8.88 23.52,9.65
SDQM0: length 14.2
  Top Layer w0.076: 24.85,18.07 23.64,16.86 23.41,16.86 23.17,16.62 23.17,16.62
  Top Layer w0.115: 24.85,18.07 24.94,18.17 25.34,18.17 27.39,20.22 31.9,20.22 31.9,20.22 32.62,20.22 32.76,20.36 33.18,20.36 33.56,19.99 33.56,18.45 33.94,18.07
SDQM1: length 23.2
  Top Layer w0.076: 22.11,16.97 22.47,16.97 23.11,17.62 23.59,17.62 23.78,17.81 23.78,18.37
  Top Layer w0.115: 39.54,18.07 39.22,18.39 39.22,20.01 38.46,20.77 38.46,21.02 38.03,21.44 35.85,21.44 35.64,21.23 35.64,20.81 35.44,20.61 34.93,20.61 34.51,21.03 34.51,21.16 34.2,21.48 26.82,21.48 23.78,18.44 23.78,18.37
SDQM2: length 13.9
  Top Layer w0.076: 24.33,9.75 23.55,10.54 23.24,10.54 22.82,10.96 22.47,10.96
  Top Layer w0.115: 24.33,9.75 24.63,9.75 26.54,7.85 29.43,7.85 31.18,6.1 32.45,6.1 33.06,6.71 33.42,6.71 33.65,6.93 33.86,6.93 33.94,7.02
